# Altium schematic sheet PRR132D02.SchDoc: Плата PRR132D
size 840 x 594 mm; Date: 14.02.22; Author: Рублёв Ю.; SheetNumber: 1; SheetTotal: 2; Title2: Схема электрическая принципиальная; Mass: not use; Primary_execution: PRR132D01; ProjectManager: Пахомов Е.
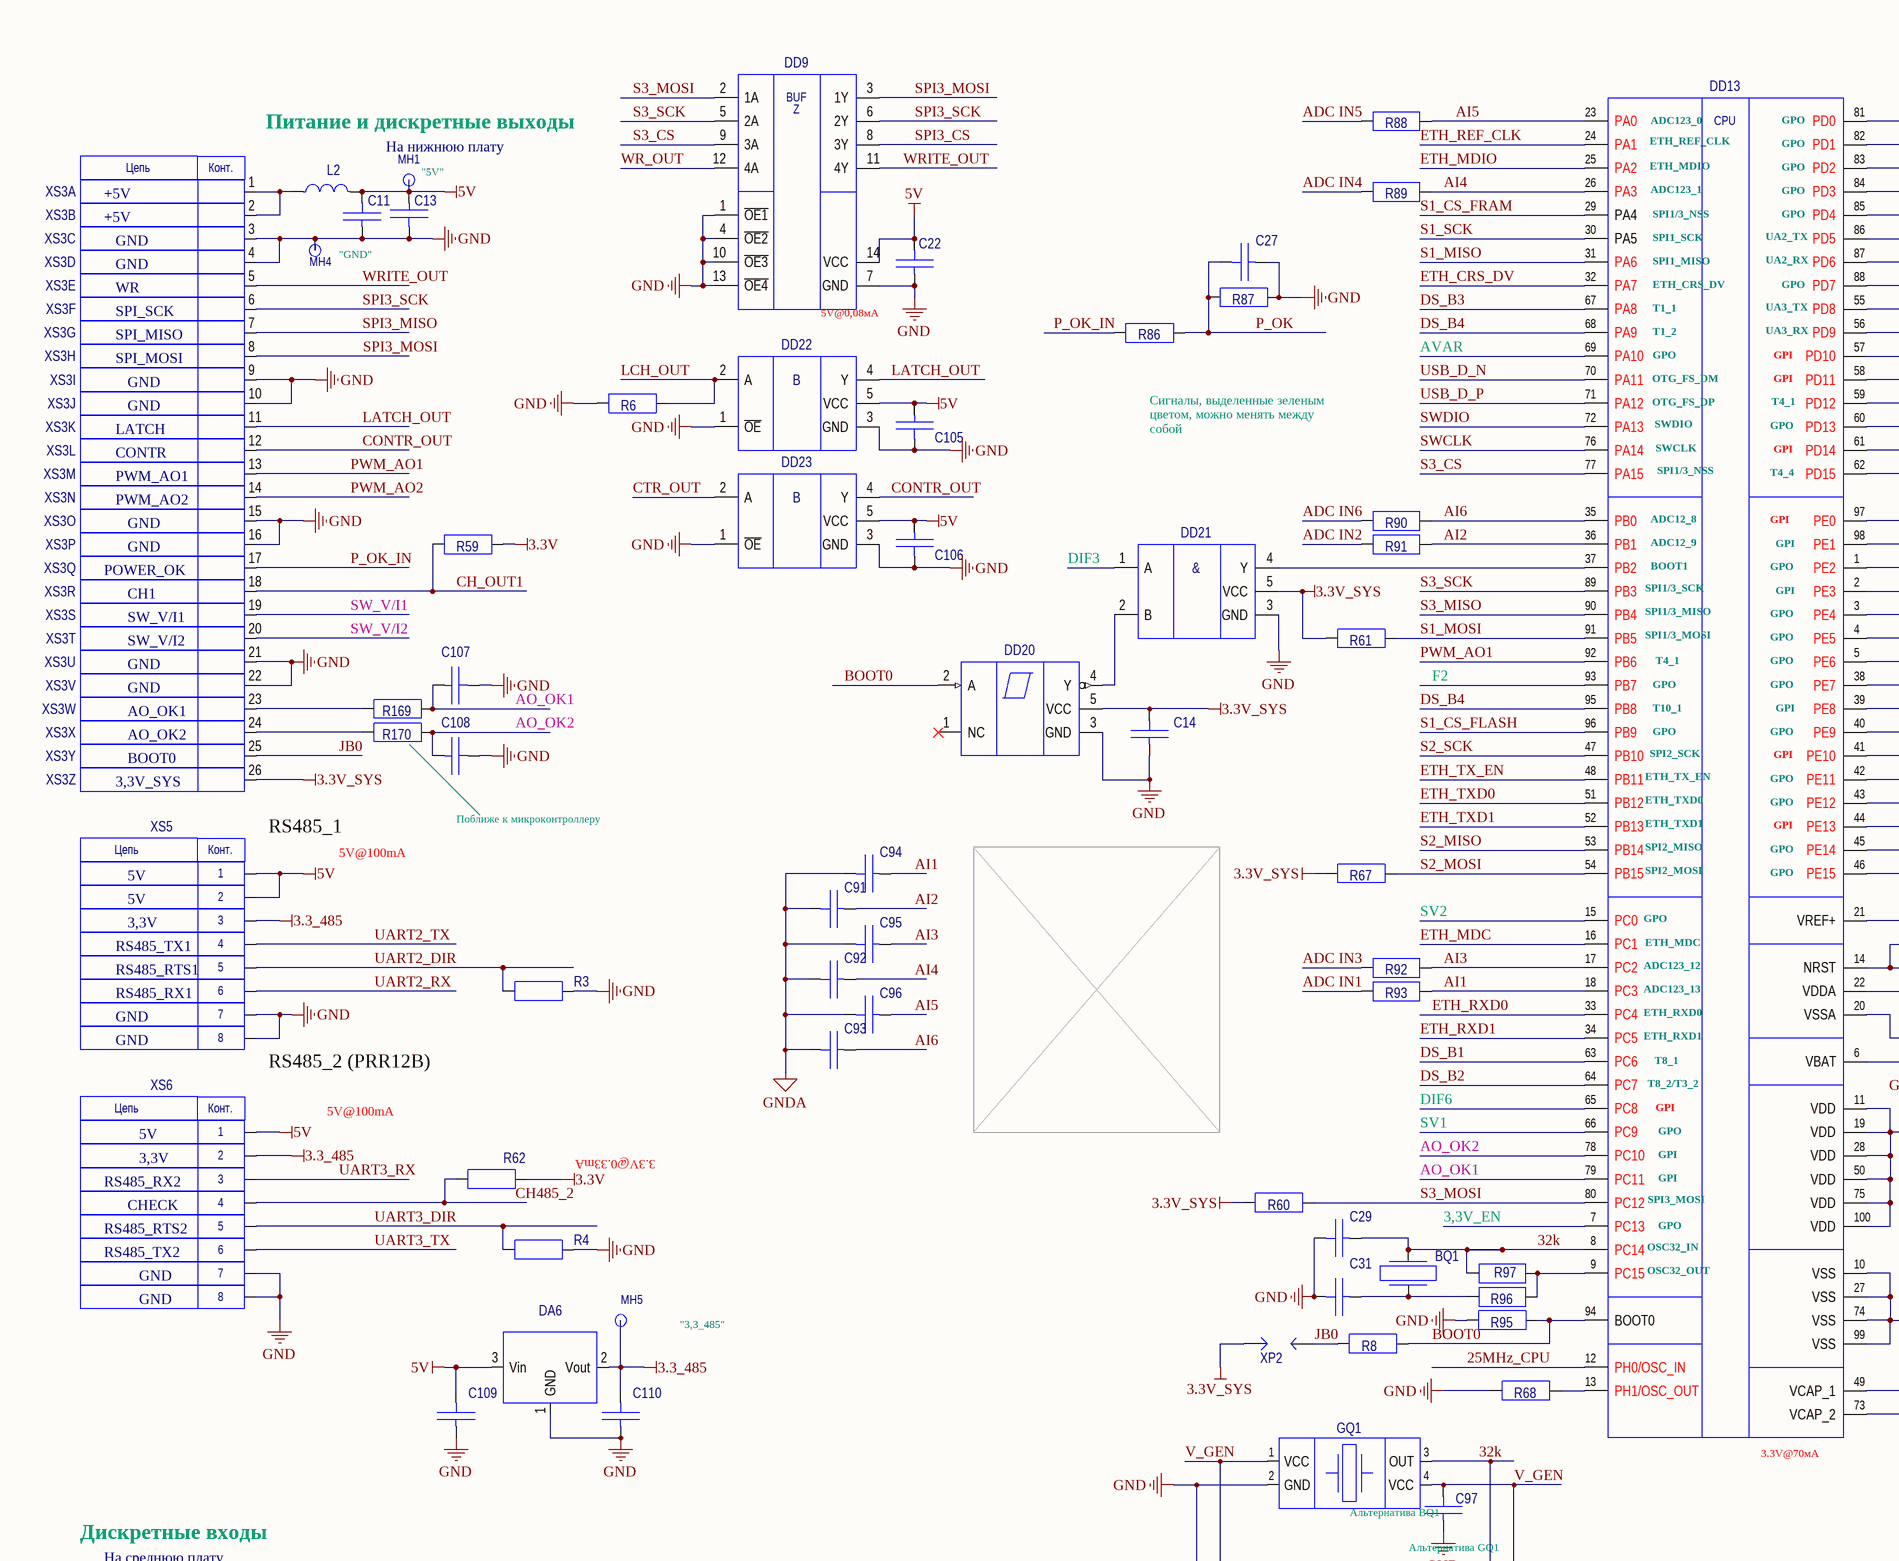
[diagram p0: PRR132D02.SchDoc, top left]
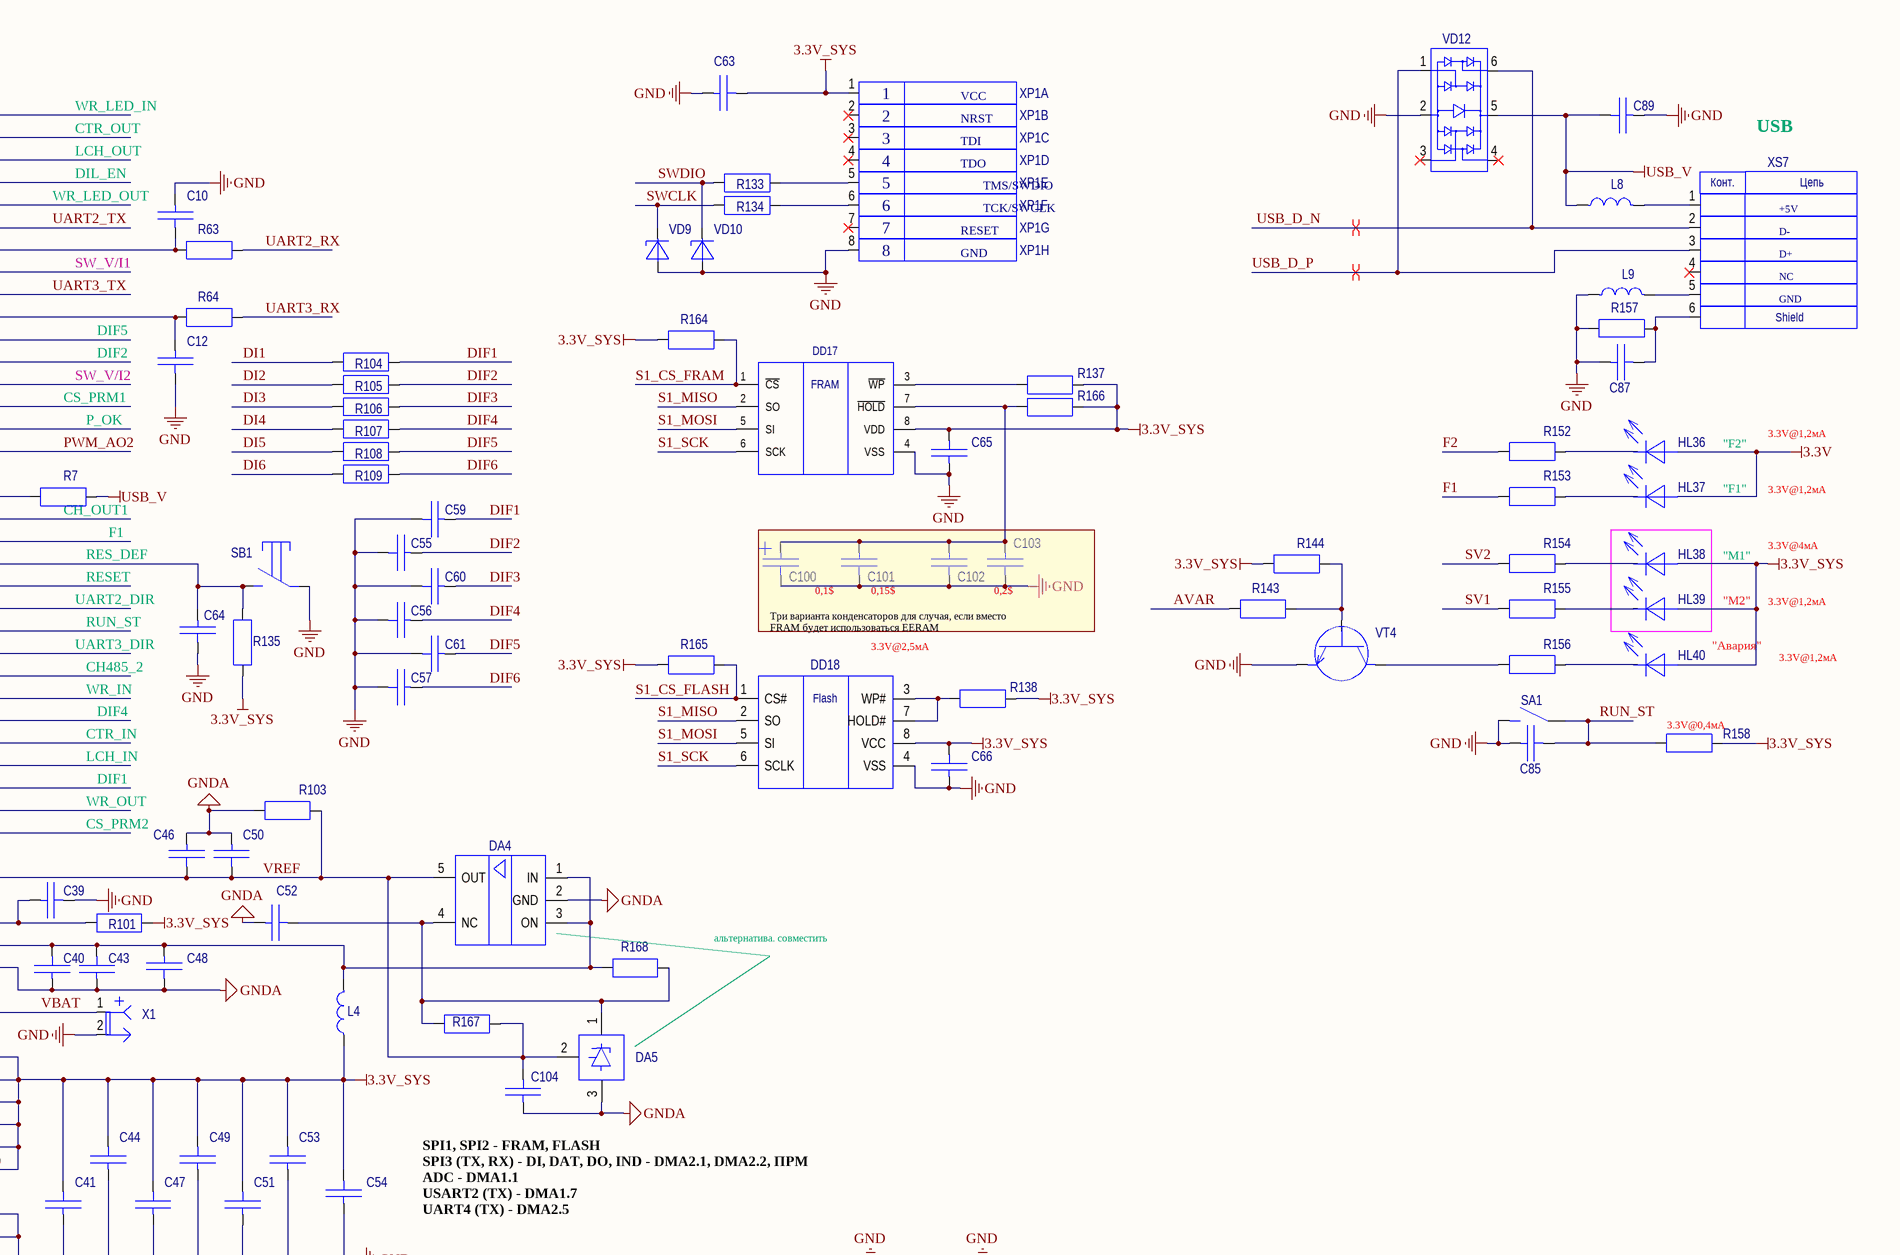
[diagram p1: PRR132D02.SchDoc, top right]
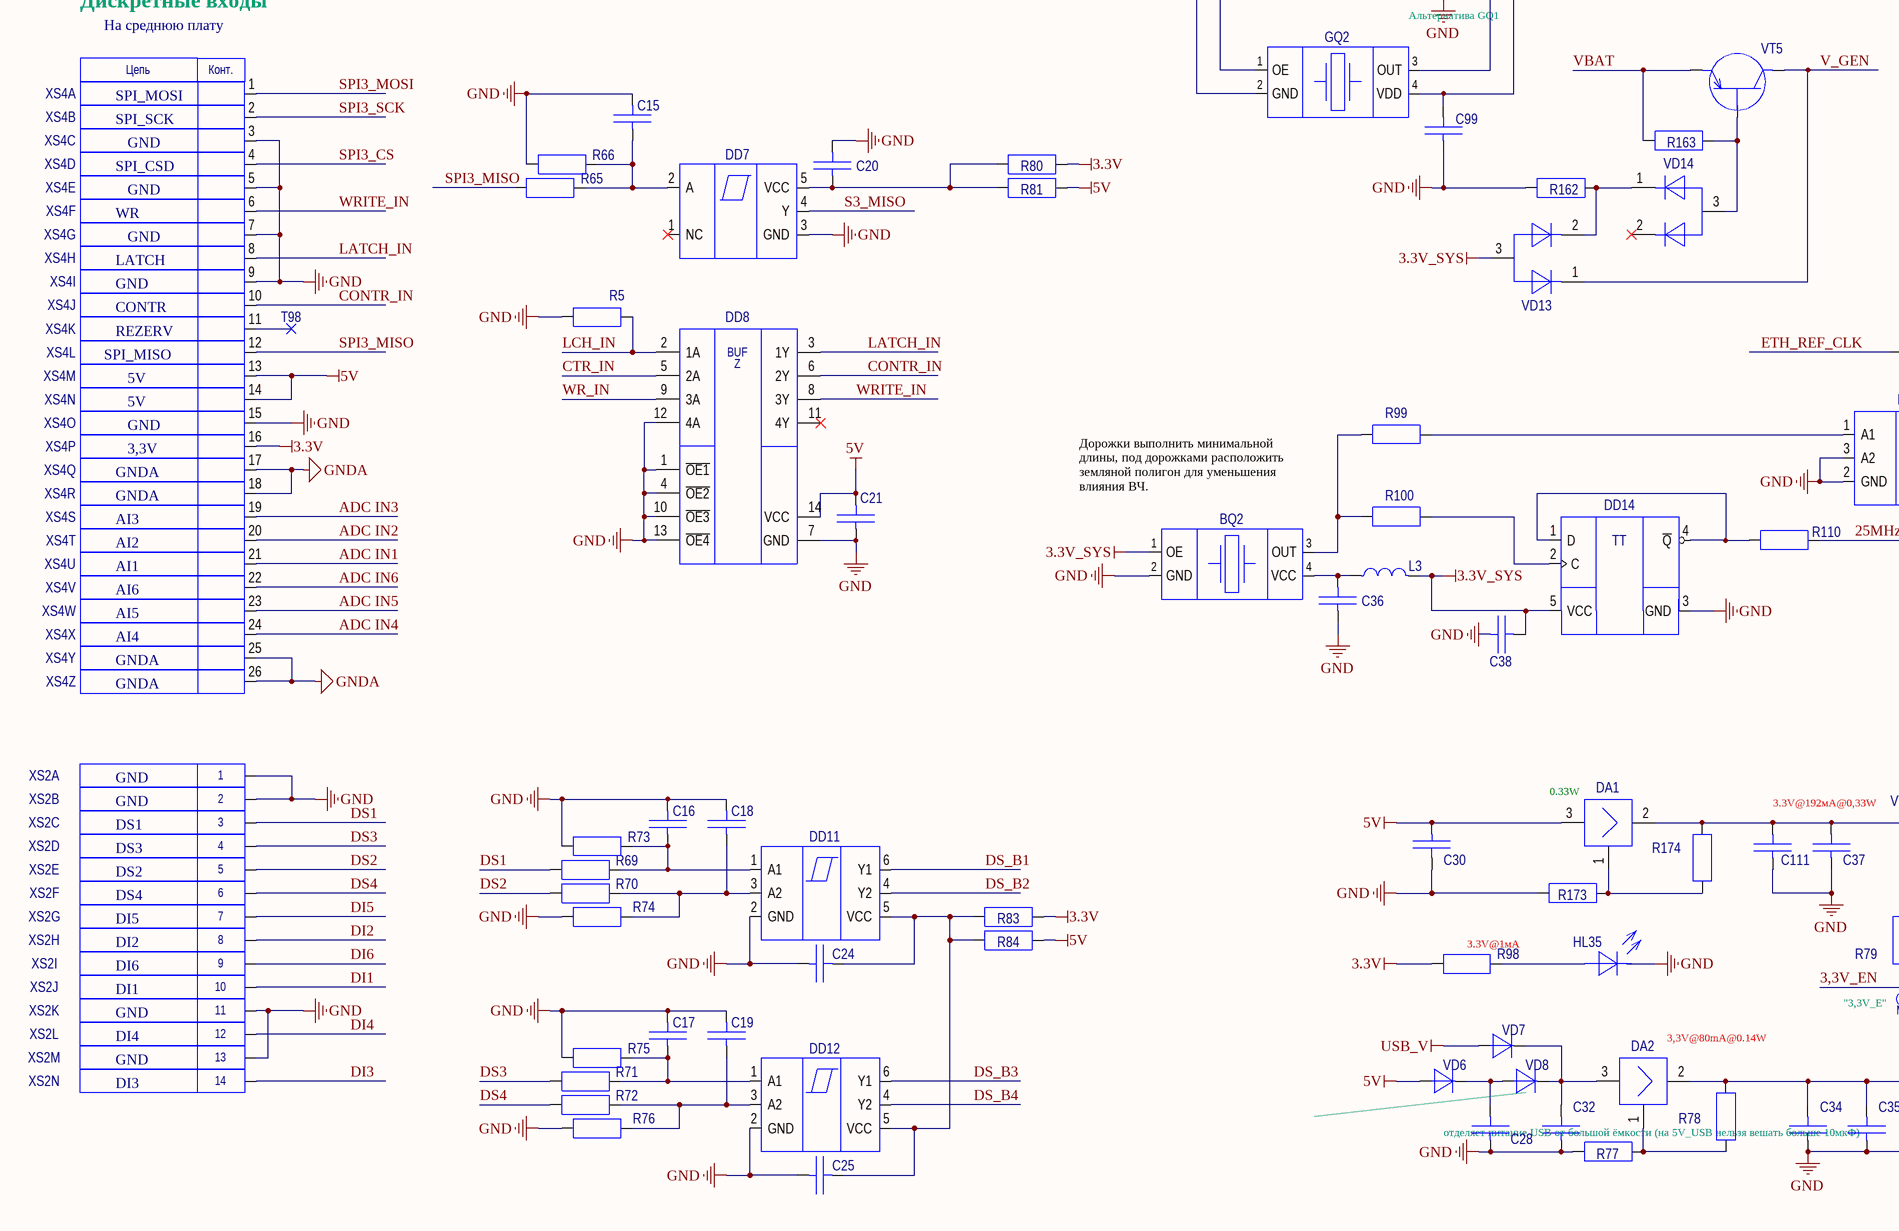
[diagram p2: PRR132D02.SchDoc, bottom left]
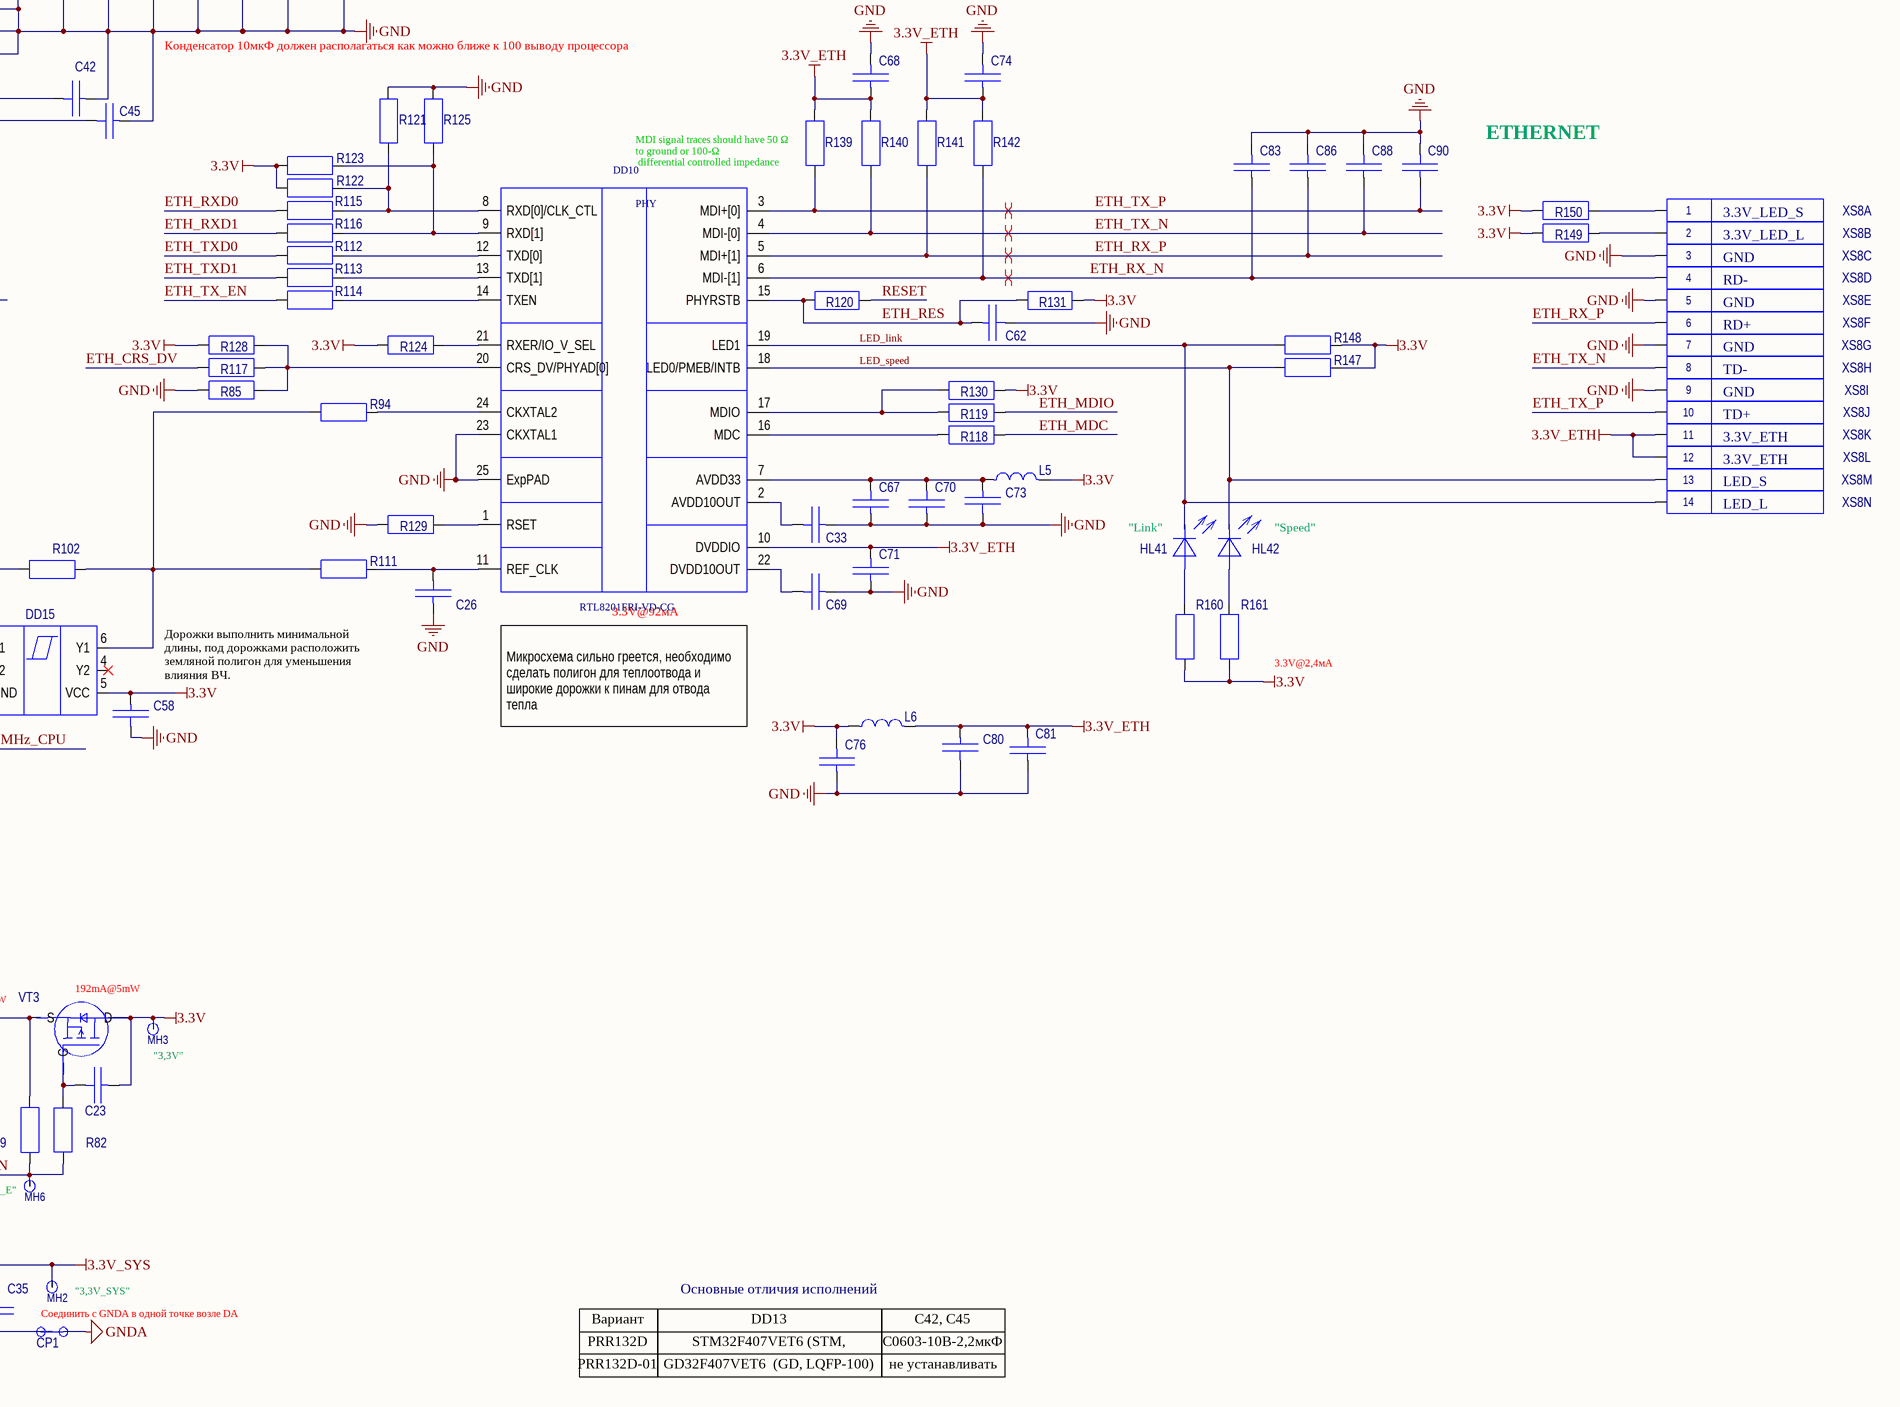
[diagram p3: PRR132D02.SchDoc, bottom right]

## Parts
(Parts that share a designator on the sheet are numbered #1, #2 ... from top to bottom, then left to right.)
*#1  *  (value not drawn)  (graphical)
*#2  *  (value not drawn)  (graphical)
BQ1  NX3215SA-32,768kHz±10ppm(25C)/±170ppm(-40/+85C)/6  [NX3215SA]  (value not drawn)
BQ2  FXO2520-3,3V-50,000MHz±50ppm 15pF (Fronter)  [FXO2520]  (value not drawn)
C10  C0402-50В-100пФ-5%-NPO (Walsin, 0402N101J500CT)  [C0402]  (value not drawn)
C11  C1206-10В-22мкФ-10%-X5R (Samsung, CL31A226KPHNNNE)  [CC1206-KL]  (value not drawn)
C12  C0402-50В-100пФ-5%-NPO (Walsin, 0402N101J500CT)  [C0402]  (value not drawn)
C13  C0402-16В-0,1мкФ-10%-X7R (CCTC, TCC0402X7R104K160AT)  [C0402]  (value not drawn)
C14  C0402-16В-0,1мкФ-10%-X7R (CCTC, TCC0402X7R104K160AT)  [C0402]  (value not drawn)
C15  C0402-50В-100пФ-5%-NPO (Walsin, 0402N101J500CT)  [C0402]  (value not drawn)
C16  C0402-50В-100пФ-5%-NPO (Walsin, 0402N101J500CT)  [C0402]  (value not drawn)
C17  C0402-50В-100пФ-5%-NPO (Walsin, 0402N101J500CT)  [C0402]  (value not drawn)
C18  C0402-50В-100пФ-5%-NPO (Walsin, 0402N101J500CT)  [C0402]  (value not drawn)
C19  C0402-50В-100пФ-5%-NPO (Walsin, 0402N101J500CT)  [C0402]  (value not drawn)
C20  C0402-16В-0,1мкФ-10%-X7R (CCTC, TCC0402X7R104K160AT)  [C0402]  (value not drawn)
C21  C0402-16В-0,1мкФ-10%-X7R (CCTC, TCC0402X7R104K160AT)  [C0402]  (value not drawn)
C22  C0402-16В-0,1мкФ-10%-X7R (CCTC, TCC0402X7R104K160AT)  [C0402]  (value not drawn)
C23  C0402-50В-0,01мкФ-10%-X7R (CCTC, TCC0402X7R103K500AT)  [C0402]  (value not drawn)
C24  C0402-16В-0,1мкФ-10%-X7R (CCTC, TCC0402X7R104K160AT)  [C0402]  (value not drawn)
C25  C0402-16В-0,1мкФ-10%-X7R (CCTC, TCC0402X7R104K160AT)  [C0402]  (value not drawn)
C26  C0402-50В-10пФ-5%-NPO (Walsin, 0402N100J500CT)  [C0402]  (value not drawn)
C27  C0402-50В-1000пФ-5%-NPO (CCTC, TCC0402COG102J500AT)  [C0402]  (value not drawn)
C28  C1210-6,3В-100мкФ-20%-X5R (Samsung, CL32A107MQVNNNE)  [C1210]  (value not drawn)
C29  C0603-50В-8,2пФ-0,25пФ-NP0 (CCTC, TCC0603COG8R2C500CT)  [CC0603-KL]  (value not drawn)
C30  C0603-6,3В-4,7мкФ-10%-X5R (Samsung, CL10A475KQ8NNN  [CC0603-KL]  (value not drawn)
C31  C0603-50В-8,2пФ-0,25пФ-NP0 (CCTC, TCC0603COG8R2C500CT)  [CC0603-KL]  (value not drawn)
C32  C0402-10В-1мкФ-10%-X5R (CCTC, TCC0402X5R105K100AT)  [C0402]  (value not drawn)
C33  C0402-16В-0,1мкФ-10%-X7R (CCTC, TCC0402X7R104K160AT)  [C0402]  (value not drawn)
C34  C0402-10В-1мкФ-10%-X5R (CCTC, TCC0402X5R105K100AT)  [C0402]  (value not drawn)
C35  C1206-10В-22мкФ-10%-X5R (Samsung, CL31A226KPHNNNE)  [CC1206-KL]  (value not drawn)
C36  C0402-16В-0,1мкФ-10%-X7R (CCTC, TCC0402X7R104K160AT)  [C0402]  (value not drawn)
C37  C0603-6,3В-4,7мкФ-10%-X5R (Samsung, CL10A475KQ8NNN  [CC0603-KL]  (value not drawn)
C38  C0402-16В-0,1мкФ-10%-X7R (CCTC, TCC0402X7R104K160AT)  [C0402]  (value not drawn)
C39  C0402-16В-0,1мкФ-10%-X7R (CCTC, TCC0402X7R104K160AT)  [C0402]  (value not drawn)
C40  C0402-50В-0,01мкФ-10%-X7R (CCTC, TCC0402X7R103K500AT)  [C0402]  (value not drawn)
C41  C0402-16В-0,1мкФ-10%-X7R (CCTC, TCC0402X7R104K160AT)  [C0402]  (value not drawn)
C42  C0603-10В-2,2мкФ-10%-X7R (Samsung, CL10B225KP8NNNC  [CC0603-KL]  (value not drawn)
C43  C0402-10В-1мкФ-10%-X5R (CCTC, TCC0402X5R105K100AT)  [C0402]  (value not drawn)
C44  C0402-16В-0,1мкФ-10%-X7R (CCTC, TCC0402X7R104K160AT)  [C0402]  (value not drawn)
C45  C0603-10В-2,2мкФ-10%-X7R (Samsung, CL10B225KP8NNNC  [CC0603-KL]  (value not drawn)
C46  C0402-10В-1мкФ-10%-X5R (CCTC, TCC0402X5R105K100AT)  [C0402]  (value not drawn)
C47  C0402-16В-0,1мкФ-10%-X7R (CCTC, TCC0402X7R104K160AT)  [C0402]  (value not drawn)
C48  C0603-10В-10мкф-10%-X5R (Samsung, CL10A106KP8NNNC)  [CC0603-KL]  (value not drawn)
C49  C0402-16В-0,1мкФ-10%-X7R (CCTC, TCC0402X7R104K160AT)  [C0402]  (value not drawn)
C50  C0402-50В-0,01мкФ-10%-X7R (CCTC, TCC0402X7R103K500AT)  [C0402]  (value not drawn)
C51  C0402-16В-0,1мкФ-10%-X7R (CCTC, TCC0402X7R104K160AT)  [C0402]  (value not drawn)
C52  C0402-50В-0,01мкФ-10%-X7R (CCTC, TCC0402X7R103K500AT)  [C0402]  (value not drawn)
C53  C0402-16В-0,1мкФ-10%-X7R (CCTC, TCC0402X7R104K160AT)  [C0402]  (value not drawn)
C54  C0603-10В-10мкф-10%-X5R (Samsung, CL10A106KP8NNNC)  [CC0603-KL]  (value not drawn)
C55  C0402-50В-100пФ-5%-NPO (Walsin, 0402N101J500CT)  [C0402]  (value not drawn)
C56  C0402-50В-100пФ-5%-NPO (Walsin, 0402N101J500CT)  [C0402]  (value not drawn)
C57  C0402-50В-100пФ-5%-NPO (Walsin, 0402N101J500CT)  [C0402]  (value not drawn)
C58  C0402-16В-0,1мкФ-10%-X7R (CCTC, TCC0402X7R104K160AT)  [C0402]  (value not drawn)
C59  C0402-50В-100пФ-5%-NPO (Walsin, 0402N101J500CT)  [C0402]  (value not drawn)
C60  C0402-50В-100пФ-5%-NPO (Walsin, 0402N101J500CT)  [C0402]  (value not drawn)
C61  C0402-50В-100пФ-5%-NPO (Walsin, 0402N101J500CT)  [C0402]  (value not drawn)
C62  C0603-10В-2,2мкФ-10%-X7R (Samsung, CL10B225KP8NNNC  [CC0603-KL]  (value not drawn)
C63  C0402-16В-0,1мкФ-10%-X7R (CCTC, TCC0402X7R104K160AT)  [C0402]  (value not drawn)
C64  C0402-50В-0,01мкФ-10%-X7R (CCTC, TCC0402X7R103K500AT)  [C0402]  (value not drawn)
C65  C0402-16В-0,1мкФ-10%-X7R (CCTC, TCC0402X7R104K160AT)  [C0402]  (value not drawn)
C66  C0402-16В-0,1мкФ-10%-X7R (CCTC, TCC0402X7R104K160AT)  [C0402]  (value not drawn)
C67  C0402-16В-0,1мкФ-10%-X7R (CCTC, TCC0402X7R104K160AT)  [C0402]  (value not drawn)
C68  C0402-16В-0,1мкФ-10%-X7R (CCTC, TCC0402X7R104K160AT)  [C0402]  (value not drawn)
C69  C0402-16В-0,1мкФ-10%-X7R (CCTC, TCC0402X7R104K160AT)  [C0402]  (value not drawn)
C70  C0402-16В-0,1мкФ-10%-X7R (CCTC, TCC0402X7R104K160AT)  [C0402]  (value not drawn)
C71  C0402-16В-0,1мкФ-10%-X7R (CCTC, TCC0402X7R104K160AT)  [C0402]  (value not drawn)
C73  C1206-16В-10мкФ-10%-X7R (Samsung, CL31B106KOHNNNE)  [CC1206-KL]  (value not drawn)
C74  C0402-16В-0,1мкФ-10%-X7R (CCTC, TCC0402X7R104K160AT)  [C0402]  (value not drawn)
C76  C0402-16В-0,1мкФ-10%-X7R (CCTC, TCC0402X7R104K160AT)  [C0402]  (value not drawn)
C80  C1206-16В-10мкФ-10%-X7R (Samsung, CL31B106KOHNNNE)  [CC1206-KL]  (value not drawn)
C81  C0402-16В-0,1мкФ-10%-X7R (CCTC, TCC0402X7R104K160AT)  [C0402]  (value not drawn)
C83  C0402-50В-10пФ-5%-NPO (Walsin, 0402N100J500CT)  [C0402]  (value not drawn)
C85  C0402-50В-1000пФ-5%-NPO (CCTC, TCC0402COG102J500AT)  [C0402]  (value not drawn)
C86  C0402-50В-10пФ-5%-NPO (Walsin, 0402N100J500CT)  [C0402]  (value not drawn)
C87  C1206-250В-4700пФ-10%-X7R (Walsin, 1206B472K251CT)  [CC1206-KL]  (value not drawn)
C88  C0402-50В-10пФ-5%-NPO (Walsin, 0402N100J500CT)  [C0402]  (value not drawn)
C89  C0402-10В-1мкФ-10%-X5R (CCTC, TCC0402X5R105K100AT)  [C0402]  (value not drawn)
C90  C0402-50В-10пФ-5%-NPO (Walsin, 0402N100J500CT)  [C0402]  (value not drawn)
C91  C0402-50В-1000пФ-5%-NPO (CCTC, TCC0402COG102J500AT)  [C0402]  (value not drawn)
C92  C0402-50В-1000пФ-5%-NPO (CCTC, TCC0402COG102J500AT)  [C0402]  (value not drawn)
C93  C0402-50В-1000пФ-5%-NPO (CCTC, TCC0402COG102J500AT)  [C0402]  (value not drawn)
C94  C0402-50В-1000пФ-5%-NPO (CCTC, TCC0402COG102J500AT)  [C0402]  (value not drawn)
C95  C0402-50В-1000пФ-5%-NPO (CCTC, TCC0402COG102J500AT)  [C0402]  (value not drawn)
C96  C0402-50В-1000пФ-5%-NPO (CCTC, TCC0402COG102J500AT)  [C0402]  (value not drawn)
C97  C0402-16В-0,1мкФ-10%-X7R (CCTC, TCC0402X7R104K160AT)  [C0402]  (value not drawn)